# EasyEDA Pro project FOX_HTOL_1.0.eprj, board PCB1 (continued)
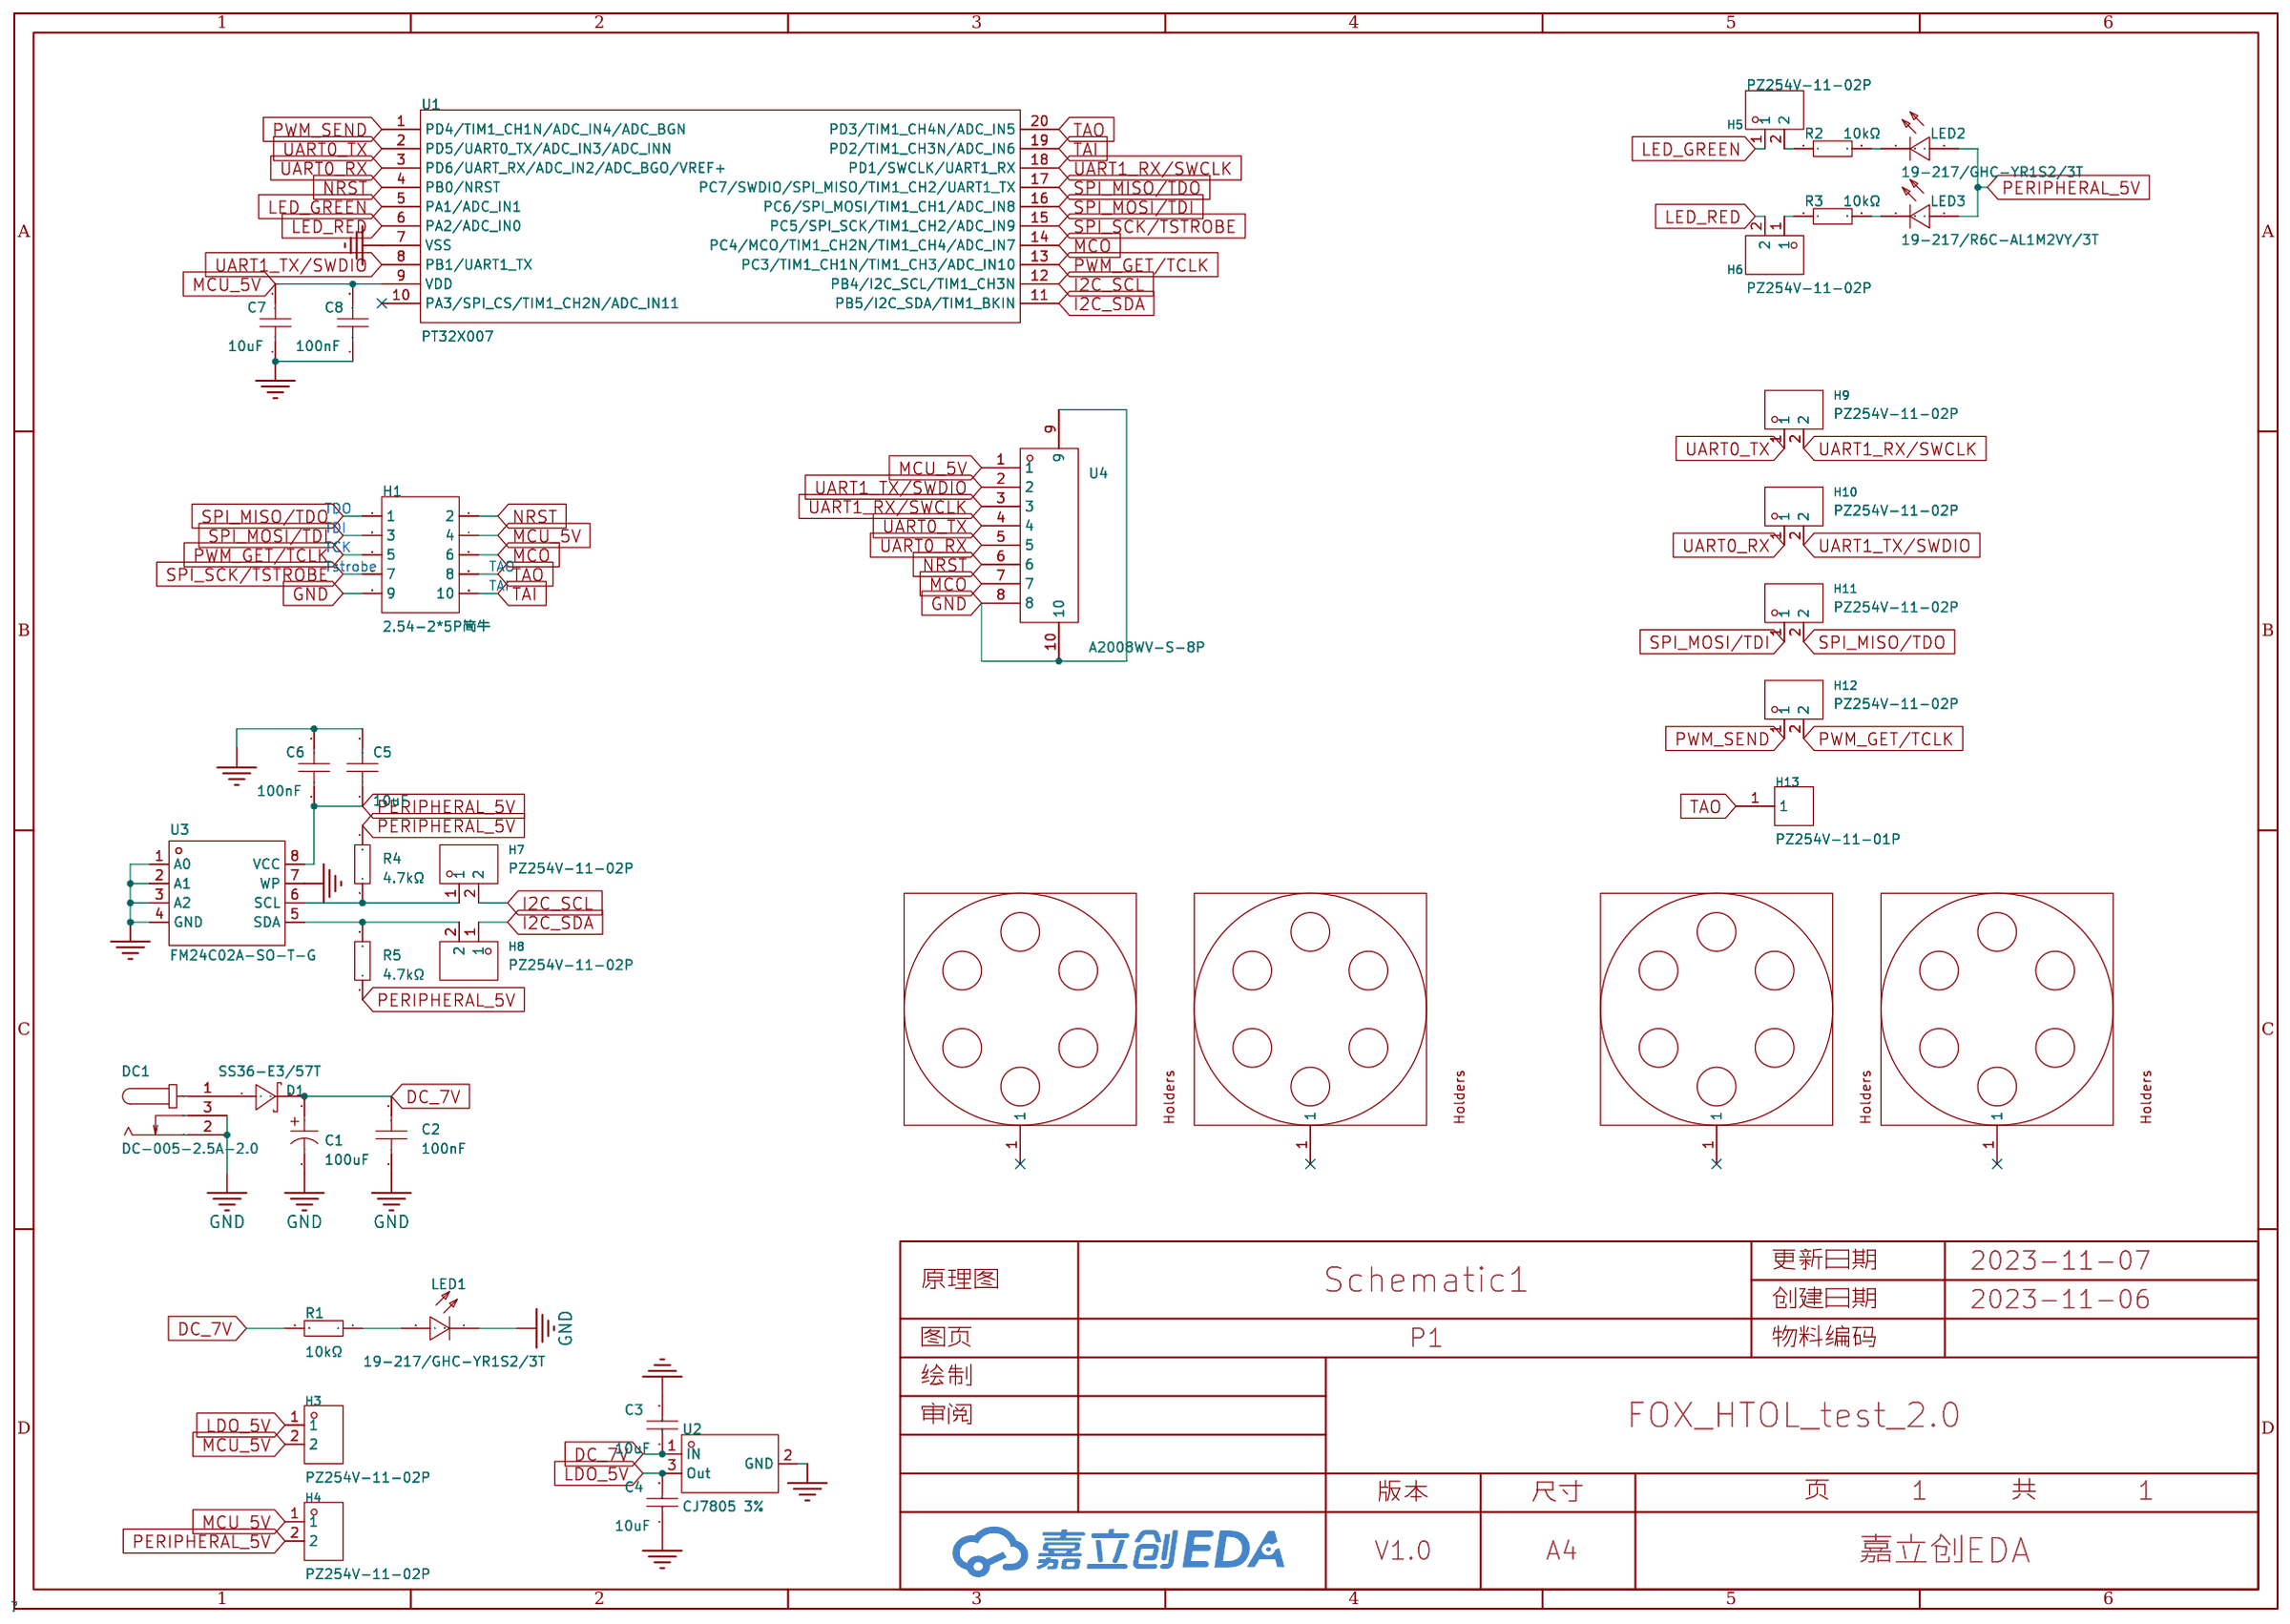
[diagram p0: schematic sheet]
## Routing (per net, layer and track width the routed paths; a pad name or vN(x,y) marks a point on that pad's centre or on a via; arc(x,y) is an arc through that point) (continued)
PERIPHERAL_5V: length 2737
  Top Layer w0.254: 140,77.89 138.78,77.89 138.74,77.93 138.66,78.01 R4#11.2 ; C5#28.1 C6#25.1 57.25,209.62 U3#26.8 ; LED3#5.2 100.34,208.28 100.33,208.27 ; R4#12.2 138.66,13.76 138.78,13.64 LED2#11.2 ; U3#30.8 57.25,145.37 C6#29.1 C5#25.1 ; C5#4.1 C6#3.1 95.67,209.62 U3#2.8 ; LED2#16.2 138.78,142.14 138.74,142.18 138.66,142.26 R4#13.2 ; R4#22.2 23.41,45.89 23.5,45.8 23.53,45.77 LED2#22.2 ; 100.33,176.14 100.34,176.16 LED3#9.2 ; C5#6.1 C6#5.1 95.67,177.5 U3#6.8 ; 138.74,204.87 138.63,204.98 R5#14.1 ; R5#31.1 61.8,237.11 61.91,237 ; R5.1 23.38,108.61 23.5,108.5 ; R4#29.2 61.83,45.89 61.91,45.8 61.95,45.77 LED2#29.2 ; LED3#31.2 61.93,176.16 61.91,176.14 ; R5#17.1 138.63,237.11 138.74,237 ; C5#5.1 C6.1 18.84,241.75 U3#5.8 ; 98.79,174.38 100.24,174.38 100.33,174.3 100.36,174.26 LED2#5.2 ; C5#16.1 C6#10.1 134.08,81.12 U3#17.8 ; 61.91,111.9 61.93,111.91 LED3#32.2 ; C5#10.1 C6#16.1 134.08,16.88 U3#12.8 ; R5#26.1 61.8,76.49 61.91,76.38 ; R5#16.1 138.63,44.36 138.74,44.25 ; U3#25.8 57.25,49 C6#30.1 C5#30.1 ; U3#29.8 57.25,177.5 C6#28.1 C5#29.1 ; C5#31.1 C6#24.1 57.25,81.12 U3#32.8 ; 101.58,238.51 100.36,238.51 100.24,238.63 98.79,238.63 ; C5#21.1 C6#21.1 18.84,81.12 U3#20.8 ; R5#23.1 61.8,12.24 61.91,12.13 ; LED3#27.2 61.93,79.79 61.91,79.77 ; R4#18.2 138.66,110.14 138.74,110.05 138.78,110.02 LED2#17.2 ; R4#20.2 23.41,78.01 23.5,77.93 23.53,77.89 24.75,77.89 ; LED3#26.2 61.93,208.28 61.91,208.27 ; 100.33,15.52 100.34,15.54 LED3#4.2 ; 138.74,111.9 138.76,111.91 LED3#18.2 ; 100.33,108.5 100.22,108.61 98.79,108.61 ; LED3#30.2 61.93,47.66 61.91,47.65 ; 61.91,204.87 61.8,204.98 R5#27.1 ; U3#23.8 18.84,113.25 C6#23.1 C5#23.1 ; LED3#28.2 61.93,240.41 61.91,240.39 ; LED3#24.2 23.51,208.28 23.5,208.27 ; 23.5,15.52 23.51,15.54 LED3#20.2 ; U3#4.8 95.67,241.75 C6#9.1 C5#9.1 ; 98.79,142.26 100.24,142.26 100.33,142.18 100.36,142.14 LED2#8.2 ; R4#16.2 138.66,174.38 138.78,174.26 LED2#14.2 ; C5#26.1 C6#26.1 57.25,113.25 U3#31.8 ; LED2#30.2 61.95,142.14 61.83,142.26 R4#28.2 ; 23.5,172.75 23.38,172.86 R5#18.1 ; LED3#8.2 100.34,47.66 100.33,47.65 ; C5#27.1 C6#27.1 18.84,209.62 U3#24.8 ; R4#15.2 138.66,238.63 138.74,238.55 138.78,238.51 140,238.51 ; LED3#12.2 138.76,208.28 138.74,208.27 ; LED3#10.2 100.34,111.91 100.33,111.9 ; 24.75,206.39 23.53,206.39 23.5,206.42 23.41,206.51 R4#24.2 ; C5#12.1 C6#12.1 134.08,113.25 U3#16.8 ; U3#22.8 18.84,49 C6#22.1 C5#22.1 ; C5#17.1 C6#17.1 134.08,241.75 U3#13.8 ; 23.5,76.38 23.38,76.49 R5#21.1 ; R5#19.1 23.38,140.74 23.5,140.62 ; 138.74,79.77 138.76,79.79 LED3#13.2 ; C5#3.1 C6#4.1 95.67,113.25 U3#8.8 ; LED2#7.2 100.36,45.77 100.33,45.8 100.24,45.89 98.79,45.89 ; U3#7.8 95.67,145.37 C6#6.1 C5#2.1 ; 100.33,237 100.22,237.11 98.79,237.11 ; 138.74,176.14 138.76,176.16 LED3#17.2 ; 98.79,204.98 100.22,204.98 100.33,204.87 ; 138.74,144.02 138.76,144.03 LED3#15.2 ; LED2#25.2 61.95,13.64 61.91,13.68 61.83,13.76 R4#27.2 ; LED2#19.2 23.53,142.14 23.41,142.26 R4#19.2 ; LED3#25.2 61.93,15.54 61.91,15.52 ; 61.91,172.75 61.8,172.86 R5#28.1 ; LED3#21.2 23.51,79.79 23.5,79.77 ; C5#20.1 C6#20.1 18.84,16.88 U3#21.8 ; 100.33,140.62 100.22,140.74 98.79,140.74 ; LED3#22.2 23.51,47.66 23.5,47.65 ; 140,206.39 138.78,206.39 138.66,206.51 R4#10.2 ; 100.33,144.02 100.34,144.03 LED3.2 ; R5#13.1 138.63,76.49 138.74,76.38 ; LED2#9.2 100.36,110.02 100.33,110.05 100.24,110.14 98.79,110.14 ; 61.91,108.5 61.8,108.61 R5#25.1 ; U3#10.8 134.08,49 C6#15.1 C5#15.1 ; R5#20.1 23.38,12.24 23.5,12.13 ; 138.74,47.65 138.76,47.66 LED3#16.2 ; 98.79,12.24 100.22,12.24 100.33,12.13 ; LED2#15.2 138.78,45.77 138.66,45.89 R4#14.2 ; R4#17.2 23.41,174.38 23.5,174.3 23.53,174.26 LED2#6.2 ; 23.5,111.9 23.51,111.91 LED3#23.2 ; 23.5,144.02 23.51,144.03 LED3#19.2 ; 63.17,77.89 61.95,77.89 61.91,77.93 61.83,78.01 R4#26.2 ; U3#11.8 134.08,209.62 C6#11.1 C5#13.1 ; 98.79,13.76 100.24,13.76 100.33,13.68 100.36,13.64 LED2#2.2 ; 61.91,44.25 61.8,44.36 R5#30.1 ; 23.5,240.39 23.51,240.41 LED3#3.2 ; R5#11.1 138.63,140.74 138.74,140.62 ; C5#14.1 C6#13.1 134.08,177.5 U3#14.8 ; LED3#2.2 23.51,176.16 23.5,176.14 ; LED2#31.2 61.95,110.02 61.83,110.14 R4#32.2 ; R4#31.2 61.83,174.38 61.91,174.3 61.95,174.26 LED2#28.2 ; 98.79,44.36 100.22,44.36 100.33,44.25 ; C5#24.1 C6#31.1 57.25,16.88 U3#27.8 ; R4#25.2 61.83,206.51 61.91,206.42 61.95,206.39 63.17,206.39 ; U3.8 95.67,49 C6#7.1 C5#7.1 ; LED3#11.2 138.76,15.54 138.74,15.52 ; U3#19.8 18.84,145.37 C6#19.1 C5#19.1 ; C5#32.1 C6#32.1 57.25,241.75 U3#28.8 ; U3#15.8 134.08,145.37 C6#14.1 C5#11.1 ; R5#22.1 23.38,44.36 23.5,44.25 ; R5#12.1 138.63,108.61 138.74,108.5 ; 98.79,206.51 100.24,206.51 100.33,206.42 100.36,206.39 101.58,206.39 ; R5#10.1 138.63,12.24 138.74,12.13 ; R4#21.2 23.41,13.76 23.5,13.68 23.53,13.64 LED2#20.2 ; 100.33,172.75 100.22,172.86 98.79,172.86 ; 98.79,78.01 100.24,78.01 100.36,77.89 101.58,77.89 ; 138.74,240.39 138.76,240.41 LED3#14.2 ; R4#23.2 23.41,110.14 23.53,110.02 LED2#23.2 ; C5.1 C6#8.1 95.67,16.88 U3#3.8 ; C5#18.1 C6#18.1 18.84,177.5 U3#18.8 ; LED3#6.2 100.34,79.79 100.33,79.77 ; 100.33,76.38 100.22,76.49 98.79,76.49 ; U3#9.8 95.67,81.12 C6#2.1 C5#8.1 ; R4#30.2 61.83,238.63 61.91,238.55 61.95,238.51 63.17,238.51 ; 138.74,172.75 138.63,172.86 R5#15.1 ; R4#3.2 23.41,238.63 23.5,238.55 23.53,238.51 24.75,238.51 ; LED3#29.2 61.93,144.03 61.91,144.02 ; 23.5,204.87 23.38,204.98 R5#29.1 ; R5#4.1 23.38,237.11 23.5,237 ; 61.91,140.62 61.8,140.74 R5#24.1 ; LED3#7.2 100.34,240.41 100.33,240.39
  Top Layer w0.5: H4#10.2 119.18,20.37 119.18,13.44 121.4,11.22 v3(138.74,11.22) 138.74,16.43 138.3,16.88 C5#10.1 ; C5#30.1 61.47,49 61.91,48.55 v3(61.91,43.35) 44.57,43.35 42.35,45.56 42.35,52.49 H4#28.2 ; C5#14.1 138.3,177.5 138.74,177.05 v3(138.74,171.84) 121.4,171.84 119.18,174.06 119.18,180.99 H4#14.2 ; C5#20.1 23.05,16.88 23.5,16.43 v3(23.5,11.22) 6.15,11.22 3.94,13.44 3.94,20.37 H4#19.2 ; C5#4.1 99.88,209.62 100.33,209.18 v3(100.33,203.97) 82.99,203.97 80.77,206.19 80.77,213.11 H4#3.2 ; H4#9.2 119.18,116.74 119.18,109.81 121.4,107.6 v3(138.74,107.6) 138.74,112.8 138.3,113.25 C5#12.1 ; C5#17.1 138.3,241.75 138.74,241.3 v3(138.74,236.09) 121.4,236.09 119.18,238.31 119.18,245.24 H4#16.2 ; C5#21.1 23.05,81.12 23.5,80.68 v3(23.5,75.47) 6.15,75.47 3.94,77.69 3.94,84.61 H4#20.2 ; C5#7.1 99.88,49 100.33,48.55 v3(100.33,43.35) 82.99,43.35 80.77,45.56 80.77,52.49 H4#5.2 ; H4#13.2 119.18,52.49 119.18,45.56 121.4,43.35 v3(138.74,43.35) 138.74,48.55 138.3,49 C5#15.1 ; H4#2.2 80.77,20.37 80.77,13.44 82.99,11.22 v3(100.33,11.22) 100.33,16.43 99.88,16.88 C5.1 ; C5#32.1 61.47,241.75 61.91,241.3 v3(61.91,236.09) 44.57,236.09 42.35,238.31 42.35,245.24 H4#31.2 ; C5#11.1 138.3,145.37 138.74,144.93 v3(138.74,139.72) 121.4,139.72 119.18,141.94 119.18,148.86 H4#12.2 ; C5#28.1 61.47,209.62 61.91,209.18 v3(61.91,203.97) 44.57,203.97 42.35,206.19 42.35,213.11 H4#26.2 ; C5#13.1 138.3,209.62 138.74,209.18 v3(138.74,203.97) 121.4,203.97 119.18,206.19 119.18,213.11 H4#11.2 ; H4#6.2 80.77,180.99 80.77,174.06 82.99,171.84 v3(100.33,171.84) 100.33,177.05 99.88,177.5 C5#6.1 ; C5#8.1 99.88,81.12 100.33,80.68 v3(100.33,75.47) 82.99,75.47 80.77,77.69 80.77,84.61 H4#7.2 ; C5#19.1 23.05,145.37 23.5,144.93 v3(23.5,139.72) 6.15,139.72 3.94,141.94 3.94,148.86 H4#18.2 ; C5#31.1 61.47,81.12 61.91,80.68 v3(61.91,75.47) 44.57,75.47 42.35,77.69 42.35,84.61 H4#30.2 ; H4#17.2 3.94,180.99 3.94,174.06 6.15,171.84 v3(23.5,171.84) 23.5,177.05 23.05,177.5 C5#18.1 ; H4#21.2 3.94,52.49 3.94,45.56 6.15,43.35 v3(23.5,43.35) 23.5,48.55 23.05,49 C5#22.1 ; C5#26.1 61.47,113.25 61.91,112.8 v3(61.91,107.6) 44.57,107.6 42.35,109.81 42.35,116.74 H4#23.2 ; H4#25.2 3.94,213.11 3.94,206.19 6.15,203.97 v3(23.5,203.97) 23.5,209.18 23.05,209.62 C5#27.1 ; C5#9.1 99.88,241.75 100.33,241.3 v3(100.33,236.09) 82.99,236.09 80.77,238.31 80.77,245.24 H4#8.2 ; H4#22.2 3.94,116.74 3.94,109.81 6.15,107.6 v3(23.5,107.6) 23.5,112.8 23.05,113.25 C5#23.1 ; H4.2 80.77,116.74 80.77,109.81 82.99,107.6 v3(100.33,107.6) 100.33,112.8 99.88,113.25 C5#3.1 ; H4#32.2 3.94,245.24 3.94,238.31 6.15,236.09 v3(23.5,236.09) 23.5,241.3 23.05,241.75 C5#5.1 ; H4#4.2 80.77,148.86 80.77,141.94 82.99,139.72 v3(100.33,139.72) 100.33,144.93 99.88,145.37 C5#2.1 ; C5#29.1 61.47,177.5 61.91,177.05 v3(61.91,171.84) 44.57,171.84 42.35,174.06 42.35,180.99 H4#29.2 ; C5#24.1 61.47,16.88 61.91,16.43 v3(61.91,11.22) 44.57,11.22 42.35,13.44 42.35,20.37 H4#24.2 ; C5#16.1 138.3,81.12 138.74,80.68 v3(138.74,75.47) 121.4,75.47 119.18,77.69 119.18,84.61 H4#15.2 ; H4#27.2 42.35,148.86 42.35,141.94 44.57,139.72 v3(61.91,139.72) 61.91,144.93 61.47,145.37 C5#25.1
  Bottom Layer w0.5: v3(100.33,203.97) 100.33,201.81 ; v3(61.91,43.35) 61.91,41.19 ; 61.91,41.19 24.47,41.19 23.5,42.16 v3(23.5,43.35) ; 61.91,41.19 100.33,41.19 ; 100.33,169.69 138.74,169.69 ; 100.33,169.69 v3(100.33,171.84) ; 100.33,169.69 61.91,169.69 ; 138.74,169.69 v3(138.74,171.84) ; 138.74,169.69 154.55,169.69 156.46,167.77 156.46,141.22 152.78,137.54 24.15,137.54 23.5,138.2 v3(23.5,139.72) ; v3(138.74,43.35) 138.74,41.19 ; 138.74,41.19 154.39,41.19 156.21,39.37 156.21,17.27 147.96,9.02 24.18,9.02 23.5,9.7 v3(23.5,11.22) ; 138.74,41.19 100.33,41.19 ; v3(100.33,11.22) 100.33,9.06 ; v3(100.33,139.72) 100.33,137.56 ; v3(23.5,107.6) 23.5,106.55 24.61,105.44 61.91,105.44 ; v3(23.5,236.09) 23.5,235.08 24.64,233.93 61.91,233.93 ; v3(61.91,11.22) 61.91,9.06 ; 138.74,233.93 153.42,233.93 156.21,231.14 156.21,205.49 152.53,201.8 24.26,201.8 23.5,202.57 v3(23.5,203.97) ; 138.74,233.93 v3(138.74,236.09) ; 138.74,233.93 100.33,233.93 ; 61.91,105.44 v3(61.91,107.6) ; 61.91,105.44 100.33,105.44 ; v3(100.33,43.35) 100.33,41.19 ; v3(138.74,107.6) 138.74,105.44 ; 138.74,105.44 100.33,105.44 ; 138.74,105.44 154.53,105.44 156.34,103.63 156.34,77.09 152.53,73.28 24.29,73.28 23.5,74.07 v3(23.5,75.47) ; 100.33,105.44 v3(100.33,107.6) ; v3(138.74,139.72) 138.74,137.56 ; v3(61.91,139.72) 61.91,137.56 ; v3(138.74,203.97) 138.74,201.81 ; v3(61.91,236.09) 61.91,233.93 ; 61.91,233.93 100.33,233.93 ; v3(61.91,75.47) 61.91,73.31 ; v3(100.33,236.09) 100.33,233.93 ; v3(138.74,11.22) 138.74,9.06 ; v3(61.91,203.97) 61.91,201.81 ; v3(61.91,171.84) 61.91,169.69 ; 61.91,169.69 24.62,169.69 23.5,170.81 v3(23.5,171.84) ; v3(100.33,75.47) 100.33,73.31 ; v3(138.74,75.47) 138.74,73.31
PWM_GET/TCLK: length 1100.5
  Top Layer w0.254: 135.94,125.39 136.33,124.99 136.33,118.9 137.19,118.04 U1#10.13 ; 135.94,125.39 135.94,127.02 H1#10.5 ; 135.94,125.39 135.91,125.41 129.82,125.41 128.71,126.52 128.71,132.11 127.44,133.38 122.11,133.38 121.6,132.87 H12#12.2 ; U1#17.13 137.19,150.16 136.33,151.02 136.33,157.12 135.94,157.51 ; H12#23.2 6.35,229.24 6.86,229.75 12.19,229.75 13.46,228.48 13.46,222.89 14.57,221.78 20.67,221.78 20.69,221.76 ; U1#12.13 137.19,21.66 136.33,22.52 136.33,28.62 135.94,29.01 ; H1#29.5 59.11,159.14 59.11,157.51 ; 59.11,93.26 59.11,94.89 H1#30.5 ; 59.11,93.26 59.5,92.87 59.5,86.77 60.36,85.91 U1#28.13 ; 59.11,93.26 59.08,93.28 52.99,93.28 51.88,94.39 51.88,99.98 50.61,101.25 45.27,101.25 44.77,100.74 H12#26.2 ; 97.52,157.51 97.52,159.14 H1#7.5 ; 97.52,157.51 97.5,157.53 91.4,157.53 90.29,158.64 90.29,164.23 89.02,165.5 83.69,165.5 83.18,164.99 H12#7.2 ; 97.52,157.51 97.91,157.12 97.91,151.02 98.78,150.16 U1#9.13 ; H12#16.2 121.6,164.99 122.11,165.5 127.44,165.5 128.71,164.23 128.71,158.64 129.82,157.53 135.91,157.53 135.94,157.51 ; 97.52,125.39 97.5,125.41 91.4,125.41 90.29,126.52 90.29,132.11 89.02,133.38 83.69,133.38 83.18,132.87 H12#2.2 ; 97.52,125.39 97.91,124.99 97.91,118.9 98.78,118.04 U1#2.13 ; 97.52,125.39 97.52,127.02 H1#3.5 ; 20.69,189.63 21.08,189.24 21.08,183.15 21.95,182.28 U1#31.13 ; 20.69,189.63 20.69,191.26 H1#31.5 ; 20.69,189.63 20.67,189.66 14.57,189.66 13.46,190.77 13.46,196.35 12.19,197.62 6.86,197.62 6.35,197.12 H12#32.2 ; U1#29.13 60.36,246.53 59.5,247.4 59.5,253.49 59.11,253.88 ; H1#4.5 97.52,255.51 97.52,253.88 ; 20.69,157.51 21.08,157.12 21.08,151.02 21.95,150.16 U1#18.13 ; 20.69,157.51 20.67,157.53 14.57,157.53 13.46,158.64 13.46,164.23 12.19,165.5 6.86,165.5 6.35,164.99 H12#18.2 ; 20.69,157.51 20.69,159.14 H1#16.5 ; 59.11,29.01 59.5,28.62 59.5,22.52 60.36,21.66 U1#26.13 ; 59.11,29.01 59.08,29.04 52.99,29.04 51.88,30.14 51.88,35.73 50.61,37 45.27,37 44.77,36.49 H12#27.2 ; 59.11,29.01 59.11,30.64 H1#23.5 ; H12#15.2 121.6,197.12 122.11,197.62 127.44,197.62 128.71,196.35 128.71,190.77 129.82,189.66 135.91,189.66 135.94,189.63 ; 59.11,61.14 59.08,61.16 52.99,61.16 51.88,62.27 51.88,67.86 50.61,69.13 45.27,69.13 44.77,68.62 H12#31.2 ; 59.11,61.14 59.11,62.77 H1#22.5 ; 59.11,61.14 59.5,60.75 59.5,54.65 60.36,53.79 U1#25.13 ; 59.11,157.51 59.5,157.12 59.5,151.02 60.36,150.16 U1#32.13 ; 59.11,157.51 59.08,157.53 52.99,157.53 51.88,158.64 51.88,164.23 50.61,165.5 45.27,165.5 44.77,164.99 H12#30.2 ; 97.52,221.76 97.52,223.39 H1#5.5 ; 97.52,221.76 97.5,221.78 91.4,221.78 90.29,222.89 90.29,228.48 89.02,229.75 83.69,229.75 83.18,229.24 H12.2 ; 97.52,221.76 97.91,221.37 97.91,215.27 98.78,214.41 U1#5.13 ; 20.69,29.01 20.67,29.04 14.57,29.04 13.46,30.14 13.46,35.73 12.19,37 6.86,37 6.35,36.49 H12#19.2 ; 20.69,29.01 20.69,30.64 H1#17.5 ; 20.69,29.01 21.08,28.62 21.08,22.52 21.95,21.66 U1#19.13 ; 20.69,125.39 20.69,127.02 H1#20.5 ; 20.69,125.39 20.67,125.41 14.57,125.41 13.46,126.52 13.46,132.11 12.19,133.38 6.86,133.38 6.35,132.87 H12#22.2 ; 20.69,125.39 21.08,124.99 21.08,118.9 21.95,118.04 U1#22.13 ; H1#27.5 59.11,223.39 59.11,221.76 ; H12#9.2 121.6,36.49 122.11,37 127.44,37 128.71,35.73 128.71,30.14 129.82,29.04 135.91,29.04 135.94,29.01 ; 135.94,61.14 136.33,60.75 136.33,54.65 137.19,53.79 U1#11.13 ; 135.94,61.14 135.91,61.16 129.82,61.16 128.71,62.27 128.71,67.86 127.44,69.13 122.11,69.13 121.6,68.62 H12#17.2 ; 135.94,61.14 135.94,62.77 H1#8.5 ; 59.11,253.88 59.08,253.91 52.99,253.91 51.88,255.02 51.88,260.6 50.61,261.87 45.27,261.87 44.77,261.37 H12#28.2 ; 59.11,253.88 59.11,255.51 H1#26.5 ; H12#10.2 6.35,261.37 6.86,261.87 12.19,261.87 13.46,260.6 13.46,255.02 14.57,253.91 20.67,253.91 20.69,253.88 ; H12#29.2 44.77,197.12 45.27,197.62 50.61,197.62 51.88,196.35 51.88,190.77 52.99,189.66 59.08,189.66 59.11,189.63 ; 135.94,253.88 136.33,253.49 136.33,247.4 137.19,246.53 U1#15.13 ; 135.94,253.88 135.91,253.91 129.82,253.91 128.71,255.02 128.71,260.6 127.44,261.87 122.11,261.87 121.6,261.37 H12#14.2 ; 135.94,253.88 135.94,255.51 H1#11.5 ; 59.11,189.63 59.11,191.26 H1#28.5 ; 59.11,189.63 59.5,189.24 59.5,183.15 60.36,182.28 U1#30.13 ; H1#9.5 135.94,30.64 135.94,29.01 ; H1#25.5 20.69,255.51 20.69,253.88 ; 97.52,61.14 97.91,60.75 97.91,54.65 98.78,53.79 U1#3.13 ; 97.52,61.14 97.52,62.77 H1#32.5 ; 97.52,61.14 97.5,61.16 91.4,61.16 90.29,62.27 90.29,67.86 89.02,69.13 83.69,69.13 83.18,68.62 H12#8.2 ; 135.94,93.26 136.33,92.87 136.33,86.77 137.19,85.91 U1#14.13 ; 135.94,93.26 135.91,93.28 129.82,93.28 128.71,94.39 128.71,99.98 127.44,101.25 122.11,101.25 121.6,100.74 H12#13.2 ; 135.94,93.26 135.94,94.89 H1#15.5 ; H12#25.2 44.77,132.87 45.27,133.38 50.61,133.38 51.88,132.11 51.88,126.52 52.99,125.41 59.08,125.41 59.11,125.39 ; U1#4.13 98.78,21.66 97.91,22.52 97.91,28.62 97.52,29.01 ; H12#4.2 83.18,36.49 83.69,37 89.02,37 90.29,35.73 90.29,30.14 91.4,29.04 97.5,29.04 97.52,29.01 ; 135.94,189.63 136.33,189.24 136.33,183.15 137.19,182.28 U1#16.13 ; 135.94,189.63 135.94,191.26 H1#13.5 ; H12#3.2 83.18,100.74 83.69,101.25 89.02,101.25 90.29,99.98 90.29,94.39 91.4,93.28 97.5,93.28 97.52,93.26 ; U1#23.13 21.95,214.41 21.08,215.27 21.08,221.37 20.69,221.76 ; U1#6.13 98.78,85.91 97.91,86.77 97.91,92.87 97.52,93.26 ; 59.11,125.39 59.11,127.02 H1#24.5 ; 59.11,125.39 59.5,124.99 59.5,118.9 60.36,118.04 U1#24.13 ; U1#8.13 98.78,182.28 97.91,183.15 97.91,189.24 97.52,189.63 ; H1#2.5 97.52,30.64 97.52,29.01 ; 20.69,61.14 21.08,60.75 21.08,54.65 21.95,53.79 U1#21.13 ; 20.69,61.14 20.69,62.77 H1#19.5 ; 20.69,61.14 20.67,61.16 14.57,61.16 13.46,62.27 13.46,67.86 12.19,69.13 6.86,69.13 6.35,68.62 H12#20.2 ; 135.94,157.51 135.94,159.14 H1#14.5 ; H1#6.5 97.52,191.26 97.52,189.63 ; 97.52,253.88 97.5,253.91 91.4,253.91 90.29,255.02 90.29,260.6 89.02,261.87 83.69,261.87 83.18,261.37 H12#5.2 ; 97.52,253.88 97.91,253.49 97.91,247.4 98.78,246.53 U1#7.13 ; U1#13.13 137.19,214.41 136.33,215.27 136.33,221.37 135.94,221.76 ; 97.52,189.63 97.5,189.66 91.4,189.66 90.29,190.77 90.29,196.35 89.02,197.62 83.69,197.62 83.18,197.12 H12#6.2 ; 20.69,221.76 20.69,223.39 H1#21.5 ; H12#11.2 121.6,229.24 122.11,229.75 127.44,229.75 128.71,228.48 128.71,222.89 129.82,221.78 135.91,221.78 135.94,221.76 ; H12#24.2 44.77,229.24 45.27,229.75 50.61,229.75 51.88,228.48 51.88,222.89 52.99,221.78 59.08,221.78 59.11,221.76 ; H12#21.2 6.35,100.74 6.86,101.25 12.19,101.25 13.46,99.98 13.46,94.39 14.57,93.28 20.67,93.28 20.69,93.26 ; U1#20.13 21.95,85.91 21.08,86.77 21.08,92.87 20.69,93.26 ; 97.52,93.26 97.52,94.89 H1.5 ; H1#12.5 135.94,223.39 135.94,221.76 ; 59.11,221.76 59.5,221.37 59.5,215.27 60.36,214.41 U1#27.13 ; 20.69,93.26 20.69,94.89 H1#18.5 ; U1.13 21.95,246.53 21.08,247.4 21.08,253.49 20.69,253.88
PWM_SEND: length 573.5
  Top Layer w0.254: H12#9.1 127.44,35.48 128.07,34.84 128.07,26.72 128.58,26.21 U1#12.1 ; H12#26.1 50.61,99.73 51.24,99.09 51.24,90.96 51.75,90.46 U1#28.1 ; U1#24.1 51.75,122.59 51.24,123.09 51.24,131.22 50.61,131.85 H12#25.1 ; U1#26.1 51.75,26.21 51.24,26.72 51.24,34.84 50.61,35.48 H12#27.1 ; H12#23.1 12.19,228.23 12.83,227.59 12.83,219.46 13.33,218.96 U1#23.1 ; U1#15.1 128.58,251.08 128.07,251.59 128.07,259.71 127.44,260.35 H12#14.1 ; U1#10.1 128.58,122.59 128.07,123.09 128.07,131.22 127.44,131.85 H12#12.1 ; H12#24.1 50.61,228.23 51.24,227.59 51.24,219.46 51.75,218.96 U1#27.1 ; U1#8.1 90.16,186.83 89.66,187.34 89.66,195.47 89.02,196.1 H12#6.1 ; H12#10.1 12.19,260.35 12.83,259.71 12.83,251.59 13.33,251.08 U1.1 ; H12#31.1 50.61,67.6 51.24,66.97 51.24,58.84 51.75,58.34 U1#25.1 ; U1#31.1 13.33,186.83 12.83,187.34 12.83,195.47 12.19,196.1 H12#32.1 ; U1#22.1 13.33,122.59 12.83,123.09 12.83,131.22 12.19,131.85 H12#22.1 ; H12#17.1 127.44,67.6 128.07,66.97 128.07,58.84 128.58,58.34 U1#11.1 ; H12#5.1 89.02,260.35 89.66,259.71 89.66,251.59 90.16,251.08 U1#7.1 ; U1#13.1 128.58,218.96 128.07,219.46 128.07,227.59 127.44,228.23 H12#11.1 ; U1#29.1 51.75,251.08 51.24,251.59 51.24,259.71 50.61,260.35 H12#28.1 ; U1#3.1 90.16,58.34 89.66,58.84 89.66,66.97 89.02,67.6 H12#8.1 ; U1#18.1 13.33,154.71 12.83,155.21 12.83,163.34 12.19,163.98 H12#18.1 ; H12.1 89.02,228.23 89.66,227.59 89.66,219.46 90.16,218.96 U1#5.1 ; U1#20.1 13.33,90.46 12.83,90.96 12.83,99.09 12.19,99.73 H12#21.1 ; H12#13.1 127.44,99.73 128.07,99.09 128.07,90.96 128.58,90.46 U1#14.1 ; H12#19.1 12.19,35.48 12.83,34.84 12.83,26.72 13.33,26.21 U1#19.1 ; H12#30.1 50.61,163.98 51.24,163.34 51.24,155.21 51.75,154.71 U1#32.1 ; U1#2.1 90.16,122.59 89.66,123.09 89.66,131.22 89.02,131.85 H12#2.1 ; U1#21.1 13.33,58.34 12.83,58.84 12.83,66.97 12.19,67.6 H12#20.1 ; U1#4.1 90.16,26.21 89.66,26.72 89.66,34.84 89.02,35.48 H12#4.1 ; U1#9.1 90.16,154.71 89.66,155.21 89.66,163.34 89.02,163.98 H12#7.1 ; H12#16.1 127.44,163.98 128.07,163.34 128.07,155.21 128.58,154.71 U1#17.1 ; H12#29.1 50.61,196.1 51.24,195.47 51.24,187.34 51.75,186.83 U1#30.1 ; U1#6.1 90.16,90.46 89.66,90.96 89.66,99.09 89.02,99.73 H12#3.1 ; H12#15.1 127.44,196.1 128.07,195.47 128.07,187.34 128.58,186.83 U1#16.1
SPI_MISO/TDO: length 1485.6
  Top Layer w0.254: v1(61.02,217.01) U1#27.17 63.98,217.01 65.97,215.02 65.97,211.59 65.09,210.7 50.23,210.7 49.34,209.81 49.34,206.64 48.7,206 45.91,206 44.77,207.14 H11#30.2 ; H11.2 121.6,46.52 122.74,45.38 125.53,45.38 126.17,46.01 126.17,49.19 127.06,50.08 141.92,50.08 142.81,50.97 142.81,54.4 140.82,56.39 U1#11.17 v1(137.85,56.39) ; H11#16.2 121.6,239.27 122.74,238.12 125.53,238.12 126.17,238.76 126.17,241.93 127.06,242.82 141.92,242.82 142.81,243.71 142.81,247.14 140.82,249.13 U1#15.17 v1(137.85,249.13) ; H11#29.2 44.77,78.65 45.91,77.5 48.7,77.5 49.34,78.14 49.34,81.31 50.23,82.2 65.09,82.2 65.97,83.09 65.97,86.52 63.98,88.51 U1#28.17 v1(61.02,88.51) ; v1(22.61,217.01) U1#23.17 25.57,217.01 27.56,215.02 27.56,211.59 26.67,210.7 11.81,210.7 10.92,209.81 10.92,206.64 10.29,206 7.49,206 6.35,207.14 H11#26.2 ; v1(61.02,24.26) U1#26.17 63.98,24.26 65.97,22.27 65.97,18.84 65.09,17.95 50.23,17.95 49.34,17.06 49.34,13.89 48.7,13.25 45.91,13.25 44.77,14.4 H11#24.2 ; H11#3.2 83.18,46.52 84.33,45.38 87.12,45.38 87.75,46.01 87.75,49.19 88.64,50.08 103.5,50.08 104.39,50.97 104.39,54.4 102.4,56.39 U1#3.17 v1(99.44,56.39) ; H11#5.2 83.18,110.77 84.33,109.63 87.12,109.63 87.75,110.26 87.75,113.44 88.64,114.33 103.5,114.33 104.39,115.22 104.39,118.64 102.4,120.64 U1#2.17 v1(99.44,120.64) ; H11#4.2 83.18,142.89 84.33,141.75 87.12,141.75 87.75,142.39 87.75,145.56 88.64,146.45 103.5,146.45 104.39,147.34 104.39,150.77 102.4,152.76 U1#9.17 v1(99.44,152.76) ; H11#2.2 83.18,14.4 84.33,13.25 87.12,13.25 87.75,13.89 87.75,17.06 88.64,17.95 103.5,17.95 104.39,18.84 104.39,22.27 102.4,24.26 U1#4.17 v1(99.44,24.26) ; v1(61.02,249.13) U1#29.17 63.98,249.13 65.97,247.14 65.97,243.71 65.09,242.82 50.23,242.82 49.34,241.93 49.34,238.76 48.7,238.12 45.91,238.12 44.77,239.27 H11#31.2 ; H11#22.2 6.35,46.52 7.49,45.38 10.29,45.38 10.92,46.01 10.92,49.19 11.81,50.08 26.67,50.08 27.56,50.97 27.56,54.4 25.57,56.39 U1#21.17 v1(22.61,56.39) ; H11#6.2 83.18,78.65 84.33,77.5 87.12,77.5 87.75,78.14 87.75,81.31 88.64,82.2 103.5,82.2 104.39,83.09 104.39,86.52 102.4,88.51 U1#6.17 v1(99.44,88.51) ; v1(61.02,184.88) U1#30.17 63.98,184.88 65.97,182.89 65.97,179.46 65.09,178.57 50.23,178.57 49.34,177.69 49.34,174.51 48.7,173.88 45.91,173.88 44.77,175.02 H11#32.2 ; v1(137.85,217.01) U1#13.17 140.82,217.01 142.81,215.02 142.81,211.59 141.92,210.7 127.06,210.7 126.17,209.81 126.17,206.64 125.53,206 122.74,206 121.6,207.14 H11#15.2 ; H11#8.2 83.18,239.27 84.33,238.12 87.12,238.12 87.75,238.76 87.75,241.93 88.64,242.82 103.5,242.82 104.39,243.71 104.39,247.14 102.4,249.13 U1#7.17 v1(99.44,249.13) ; v1(61.02,56.39) U1#25.17 63.98,56.39 65.97,54.4 65.97,50.97 65.09,50.08 50.23,50.08 49.34,49.19 49.34,46.01 48.7,45.38 45.91,45.38 44.77,46.52 H11#25.2 ; H11#12.2 121.6,142.89 122.74,141.75 125.53,141.75 126.17,142.39 126.17,145.56 127.06,146.45 141.92,146.45 142.81,147.34 142.81,150.77 140.82,152.76 U1#17.17 v1(137.85,152.76) ; H11#19.2 6.35,142.89 7.49,141.75 10.29,141.75 10.92,142.39 10.92,145.56 11.81,146.45 26.67,146.45 27.56,147.34 27.56,150.77 25.57,152.76 U1#18.17 v1(22.61,152.76) ; H11#20.2 6.35,14.4 7.49,13.25 10.29,13.25 10.92,13.89 10.92,17.06 11.81,17.95 26.67,17.95 27.56,18.84 27.56,22.27 25.57,24.26 U1#19.17 v1(22.61,24.26) ; v1(61.02,120.64) U1#24.17 63.98,120.64 65.97,118.64 65.97,115.22 65.09,114.33 50.23,114.33 49.34,113.44 49.34,110.26 48.7,109.63 45.91,109.63 44.77,110.77 H11#28.2 ; v1(99.44,184.88) U1#8.17 102.4,184.88 104.39,182.89 104.39,179.46 103.5,178.57 88.64,178.57 87.75,177.69 87.75,174.51 87.12,173.88 84.33,173.88 83.18,175.02 H11#10.2 ; H11#23.2 6.35,110.77 7.49,109.63 10.29,109.63 10.92,110.26 10.92,113.44 11.81,114.33 26.67,114.33 27.56,115.22 27.56,118.64 25.57,120.64 U1#22.17 v1(22.61,120.64) ; v1(137.85,184.88) U1#16.17 140.82,184.88 142.81,182.89 142.81,179.46 141.92,178.57 127.06,178.57 126.17,177.69 126.17,174.51 125.53,173.88 122.74,173.88 121.6,175.02 H11#18.2 ; v1(22.61,184.88) U1#31.17 25.57,184.88 27.56,182.89 27.56,179.46 26.67,178.57 11.81,178.57 10.92,177.69 10.92,174.51 10.29,173.88 7.49,173.88 6.35,175.02 H11#17.2 ; H11#21.2 6.35,78.65 7.49,77.5 10.29,77.5 10.92,78.14 10.92,81.31 11.81,82.2 26.67,82.2 27.56,83.09 27.56,86.52 25.57,88.51 U1#20.17 v1(22.61,88.51) ; H11#14.2 121.6,78.65 122.74,77.5 125.53,77.5 126.17,78.14 126.17,81.31 127.06,82.2 141.92,82.2 142.81,83.09 142.81,86.52 140.82,88.51 U1#14.17 v1(137.85,88.51) ; H11#7.2 83.18,207.14 84.33,206 87.12,206 87.75,206.64 87.75,209.81 88.64,210.7 103.5,210.7 104.39,211.59 104.39,215.02 102.4,217.01 U1#5.17 v1(99.44,217.01) ; H11#9.2 6.35,239.27 7.49,238.12 10.29,238.12 10.92,238.76 10.92,241.93 11.81,242.82 26.67,242.82 27.56,243.71 27.56,247.14 25.57,249.13 U1.17 v1(22.61,249.13) ; H11#27.2 44.77,142.89 45.91,141.75 48.7,141.75 49.34,142.39 49.34,145.56 50.23,146.45 65.09,146.45 65.97,147.34 65.97,150.77 63.98,152.76 U1#32.17 v1(61.02,152.76) ; H11#11.2 121.6,14.4 122.74,13.25 125.53,13.25 126.17,13.89 126.17,17.06 127.06,17.95 141.92,17.95 142.81,18.84 142.81,22.27 140.82,24.26 U1#12.17 v1(137.85,24.26) ; v1(137.85,120.64) U1#10.17 140.82,120.64 142.81,118.64 142.81,115.22 141.92,114.33 127.06,114.33 126.17,113.44 126.17,110.26 125.53,109.63 122.74,109.63 121.6,110.77 H11#13.2
  Bottom Layer w0.254: v1(22.61,120.64) 22.39,120.64 19.05,123.98 17.53,123.98 16.13,125.38 H1#20.1 ; v1(137.85,120.64) 137.64,120.64 134.3,123.98 132.77,123.98 131.38,125.38 H1#10.1 ; H1#5.1 92.96,221.75 94.36,220.35 95.88,220.35 99.22,217.01 v1(99.44,217.01) ; v1(61.02,24.26) 60.81,24.26 57.47,27.6 55.94,27.6 54.55,29 H1#23.1 ; v1(99.44,184.88) 99.22,184.88 95.88,188.23 94.36,188.23 92.96,189.62 H1#6.1 ; v1(137.85,88.51) 137.64,88.51 134.3,91.85 132.77,91.85 131.38,93.25 H1#15.1 ; H1#14.1 131.38,157.5 132.77,156.1 134.3,156.1 137.64,152.76 v1(137.85,152.76) ; H1#30.1 54.55,93.25 55.94,91.85 57.47,91.85 60.81,88.51 v1(61.02,88.51) ; v1(99.44,152.76) 99.22,152.76 95.88,156.1 94.36,156.1 92.96,157.5 H1#7.1 ; H1#26.1 54.55,253.87 55.94,252.48 57.47,252.48 60.81,249.13 v1(61.02,249.13) ; v1(99.44,249.13) 99.22,249.13 95.88,252.48 94.36,252.48 92.96,253.87 H1#4.1 ; H1#19.1 16.13,61.13 17.53,59.73 19.05,59.73 22.39,56.39 v1(22.61,56.39) ; v1(99.44,24.26) 99.22,24.26 95.88,27.6 94.36,27.6 92.96,29 H1#2.1 ; H1#16.1 16.13,157.5 17.53,156.1 19.05,156.1 22.39,152.76 v1(22.61,152.76) ; v1(137.85,24.26) 137.64,24.26 134.3,27.6 132.77,27.6 131.38,29 H1#9.1 ; H1#18.1 16.13,93.25 17.53,91.85 19.05,91.85 22.39,88.51 v1(22.61,88.51) ; H1#32.1 92.96,61.13 94.36,59.73 95.88,59.73 99.22,56.39 v1(99.44,56.39) ; H1.1 92.96,93.25 94.36,91.85 95.88,91.85 99.22,88.51 v1(99.44,88.51) ; H1#22.1 54.55,61.13 55.94,59.73 57.47,59.73 60.81,56.39 v1(61.02,56.39) ; H1#29.1 54.55,157.5 55.94,156.1 57.47,156.1 60.81,152.76 v1(61.02,152.76) ; H1#25.1 16.13,253.87 17.53,252.48 19.05,252.48 22.39,249.13 v1(22.61,249.13) ; v1(22.61,184.88) 22.39,184.88 19.05,188.23 17.53,188.23 16.13,189.62 H1#31.1 ; v1(137.85,56.39) 137.64,56.39 134.3,59.73 132.77,59.73 131.38,61.13 H1#8.1 ; v1(61.02,120.64) 60.81,120.64 57.47,123.98 55.94,123.98 54.55,125.38 H1#24.1 ; H1#21.1 16.13,221.75 17.53,220.35 19.05,220.35 22.39,217.01 v1(22.61,217.01) ; H1#13.1 131.38,189.62 132.77,188.23 134.3,188.23 137.64,184.88 v1(137.85,184.88) ; v1(22.61,24.26) 22.39,24.26 19.05,27.6 17.53,27.6 16.13,29 H1#17.1 ; H1#27.1 54.55,221.75 55.94,220.35 57.47,220.35 60.81,217.01 v1(61.02,217.01) ; v1(99.44,120.64) 99.22,120.64 95.88,123.98 94.36,123.98 92.96,125.38 H1#3.1 ; v1(137.85,217.01) 137.64,217.01 134.3,220.35 132.77,220.35 131.38,221.75 H1#12.1 ; v1(137.85,249.13) 137.64,249.13 134.3,252.48 132.77,252.48 131.38,253.87 H1#11.1 ; v1(61.02,184.88) 60.81,184.88 57.47,188.23 55.94,188.23 54.55,189.62 H1#28.1
SPI_MOSI/TDI: length 1439.8
  Top Layer w0.254: H1#22.3 58.36,64.56 62.8,64.56 63.44,63.92 63.44,62.65 60.44,59.65 60.44,55.99 60.69,55.74 U1#25.16 63.75,55.74 65.34,54.14 65.34,51.22 64.71,50.59 49.88,50.59 47.31,48.01 H11#25.1 ; H1#18.3 19.94,96.68 24.38,96.68 25.02,96.04 25.02,94.77 22.02,91.78 22.02,88.11 22.28,87.86 25.33,87.86 26.92,86.27 26.92,83.34 26.29,82.71 11.46,82.71 8.89,80.14 H11#21.1 ; H1#27.3 58.36,225.18 62.8,225.18 63.44,224.54 63.44,223.27 60.44,220.28 60.44,216.61 60.69,216.36 U1#27.16 63.75,216.36 65.34,214.76 65.34,211.84 64.71,211.21 49.88,211.21 47.31,208.64 H11#30.1 ; H11#12.1 124.14,144.39 126.71,146.96 141.54,146.96 142.17,147.59 142.17,150.51 140.58,152.11 U1#17.16 137.52,152.11 137.27,152.36 137.27,156.03 140.27,159.02 140.27,160.29 139.63,160.93 135.19,160.93 H1#14.3 ; H1#10.3 135.19,128.8 139.63,128.8 140.27,128.17 140.27,126.9 137.27,123.9 137.27,120.24 137.52,119.98 U1#10.16 140.58,119.98 142.17,118.39 142.17,115.47 141.54,114.83 126.71,114.83 124.14,112.26 H11#13.1 ; H1#19.3 19.94,64.56 24.38,64.56 25.02,63.92 25.02,62.65 22.02,59.65 22.02,55.99 22.28,55.74 U1#21.16 25.33,55.74 26.92,54.14 26.92,51.22 26.29,50.59 11.46,50.59 8.89,48.01 H11#22.1 ; H1#25.3 19.94,257.3 24.38,257.3 25.02,256.67 25.02,255.4 22.02,252.4 22.02,248.74 22.28,248.48 25.33,248.48 26.92,246.89 26.92,243.97 26.29,243.33 11.46,243.33 8.89,240.76 H11#9.1 ; H11#3.1 85.72,48.01 88.29,50.59 103.12,50.59 103.76,51.22 103.76,54.14 102.16,55.74 U1#3.16 99.11,55.74 98.85,55.99 98.85,59.65 101.85,62.65 101.85,63.92 101.22,64.56 96.77,64.56 H1#32.3 ; H11#24.1 47.31,15.89 49.88,18.46 64.71,18.46 65.34,19.1 65.34,22.02 63.75,23.61 U1#26.16 60.69,23.61 60.44,23.87 60.44,27.53 63.44,30.53 63.44,31.8 62.8,32.43 58.36,32.43 H1#23.3 ; H11#29.1 47.31,80.14 49.88,82.71 64.71,82.71 65.34,83.34 65.34,86.27 63.75,87.86 60.69,87.86 60.44,88.11 60.44,91.78 63.44,94.77 63.44,96.04 62.8,96.68 58.36,96.68 H1#30.3 ; H1#12.3 135.19,225.18 139.63,225.18 140.27,224.54 140.27,223.27 137.27,220.28 137.27,216.61 137.52,216.36 U1#13.16 140.58,216.36 142.17,214.76 142.17,211.84 141.54,211.21 126.71,211.21 124.14,208.64 H11#15.1 ; H11#19.1 8.89,144.39 11.46,146.96 26.29,146.96 26.92,147.59 26.92,150.51 25.33,152.11 U1#18.16 22.28,152.11 22.02,152.36 22.02,156.03 25.02,159.02 25.02,160.29 24.38,160.93 19.94,160.93 H1#16.3 ; H11#32.1 47.31,176.51 49.88,179.08 64.71,179.08 65.34,179.72 65.34,182.64 63.75,184.23 U1#30.16 60.69,184.23 60.44,184.49 60.44,188.15 63.44,191.15 63.44,192.42 62.8,193.05 58.36,193.05 H1#28.3 ; H11#4.1 85.72,144.39 88.29,146.96 103.12,146.96 103.76,147.59 103.76,150.51 102.16,152.11 U1#9.16 99.11,152.11 98.85,152.36 98.85,156.03 101.85,159.02 101.85,160.29 101.22,160.93 96.77,160.93 H1#7.3 ; H11#31.1 47.31,240.76 49.88,243.33 64.71,243.33 65.34,243.97 65.34,246.89 63.75,248.48 60.69,248.48 60.44,248.74 60.44,252.4 63.44,255.4 63.44,256.67 62.8,257.3 58.36,257.3 H1#26.3 ; H11#5.1 85.72,112.26 88.29,114.83 103.12,114.83 103.76,115.47 103.76,118.39 102.16,119.98 U1#2.16 99.11,119.98 98.85,120.24 98.85,123.9 101.85,126.9 101.85,128.17 101.22,128.8 96.77,128.8 H1#3.3 ; H11#27.1 47.31,144.39 49.88,146.96 64.71,146.96 65.34,147.59 65.34,150.51 63.75,152.11 U1#32.16 60.69,152.11 60.44,152.36 60.44,156.03 63.44,159.02 63.44,160.29 62.8,160.93 58.36,160.93 H1#29.3 ; H11.1 124.14,48.01 126.71,50.59 141.54,50.59 142.17,51.22 142.17,54.14 140.58,55.74 U1#11.16 137.52,55.74 137.27,55.99 137.27,59.65 140.27,62.65 140.27,63.92 139.63,64.56 135.19,64.56 H1#8.3 ; H11#11.1 124.14,15.89 126.71,18.46 141.54,18.46 142.17,19.1 142.17,22.02 140.58,23.61 U1#12.16 137.52,23.61 137.27,23.87 137.27,27.53 140.27,30.53 140.27,31.8 139.63,32.43 135.19,32.43 H1#9.3 ; H11#18.1 124.14,176.51 126.71,179.08 141.54,179.08 142.17,179.72 142.17,182.64 140.58,184.23 U1#16.16 137.52,184.23 137.27,184.49 137.27,188.15 140.27,191.15 140.27,192.42 139.63,193.05 135.19,193.05 H1#13.3 ; H1#5.3 96.77,225.18 101.22,225.18 101.85,224.54 101.85,223.27 98.85,220.28 98.85,216.61 99.11,216.36 U1#5.16 102.16,216.36 103.76,214.76 103.76,211.84 103.12,211.21 88.29,211.21 85.72,208.64 H11#7.1 ; H11#23.1 8.89,112.26 11.46,114.83 26.29,114.83 26.92,115.47 26.92,118.39 25.33,119.98 U1#22.16 22.28,119.98 22.02,120.24 22.02,123.9 25.02,126.9 25.02,128.17 24.38,128.8 19.94,128.8 H1#20.3 ; H11#8.1 85.72,240.76 88.29,243.33 103.12,243.33 103.76,243.97 103.76,246.89 102.16,248.48 99.11,248.48 98.85,248.74 98.85,252.4 101.85,255.4 101.85,256.67 101.22,257.3 96.77,257.3 H1#4.3 ; H11#20.1 8.89,15.89 11.46,18.46 26.29,18.46 26.92,19.1 26.92,22.02 25.33,23.61 U1#19.16 22.28,23.61 22.02,23.87 22.02,27.53 25.02,30.53 25.02,31.8 24.38,32.43 19.94,32.43 H1#17.3 ; H1#24.3 58.36,128.8 62.8,128.8 63.44,128.17 63.44,126.9 60.44,123.9 60.44,120.24 60.69,119.98 U1#24.16 63.75,119.98 65.34,118.39 65.34,115.47 64.71,114.83 49.88,114.83 47.31,112.26 H11#28.1 ; H1#31.3 19.94,193.05 24.38,193.05 25.02,192.42 25.02,191.15 22.02,188.15 22.02,184.49 22.28,184.23 U1#31.16 25.33,184.23 26.92,182.64 26.92,179.72 26.29,179.08 11.46,179.08 8.89,176.51 H11#17.1 ; H11#10.1 85.72,176.51 88.29,179.08 103.12,179.08 103.76,179.72 103.76,182.64 102.16,184.23 U1#8.16 99.11,184.23 98.85,184.49 98.85,188.15 101.85,191.15 101.85,192.42 101.22,193.05 96.77,193.05 H1#6.3 ; H11#2.1 85.72,15.89 88.29,18.46 103.12,18.46 103.76,19.1 103.76,22.02 102.16,23.61 U1#4.16 99.11,23.61 98.85,23.87 98.85,27.53 101.85,30.53 101.85,31.8 101.22,32.43 96.77,32.43 H1#2.3 ; H1#21.3 19.94,225.18 24.38,225.18 25.02,224.54 25.02,223.27 22.02,220.28 22.02,216.61 22.28,216.36 U1#23.16 25.33,216.36 26.92,214.76 26.92,211.84 26.29,211.21 11.46,211.21 8.89,208.64 H11#26.1 ; H11#6.1 85.72,80.14 88.29,82.71 103.12,82.71 103.76,83.34 103.76,86.27 102.16,87.86 99.11,87.86 98.85,88.11 98.85,91.78 101.85,94.77 101.85,96.04 101.22,96.68 96.77,96.68 H1.3 ; H1#15.3 135.19,96.68 139.63,96.68 140.27,96.04 140.27,94.77 137.27,91.78 137.27,88.11 137.52,87.86 140.58,87.86 142.17,86.27 142.17,83.34 141.54,82.71 126.71,82.71 124.14,80.14 H11#14.1 ; H1#11.3 135.19,257.3 139.63,257.3 140.27,256.67 140.27,255.4 137.27,252.4 137.27,248.74 137.52,248.48 140.58,248.48 142.17,246.89 142.17,243.97 141.54,243.33 126.71,243.33 124.14,240.76 H11#16.1